# EasyEDA Pro project 立创天空星STM32F407主板.eprj, schematic Schematic1 (continued)
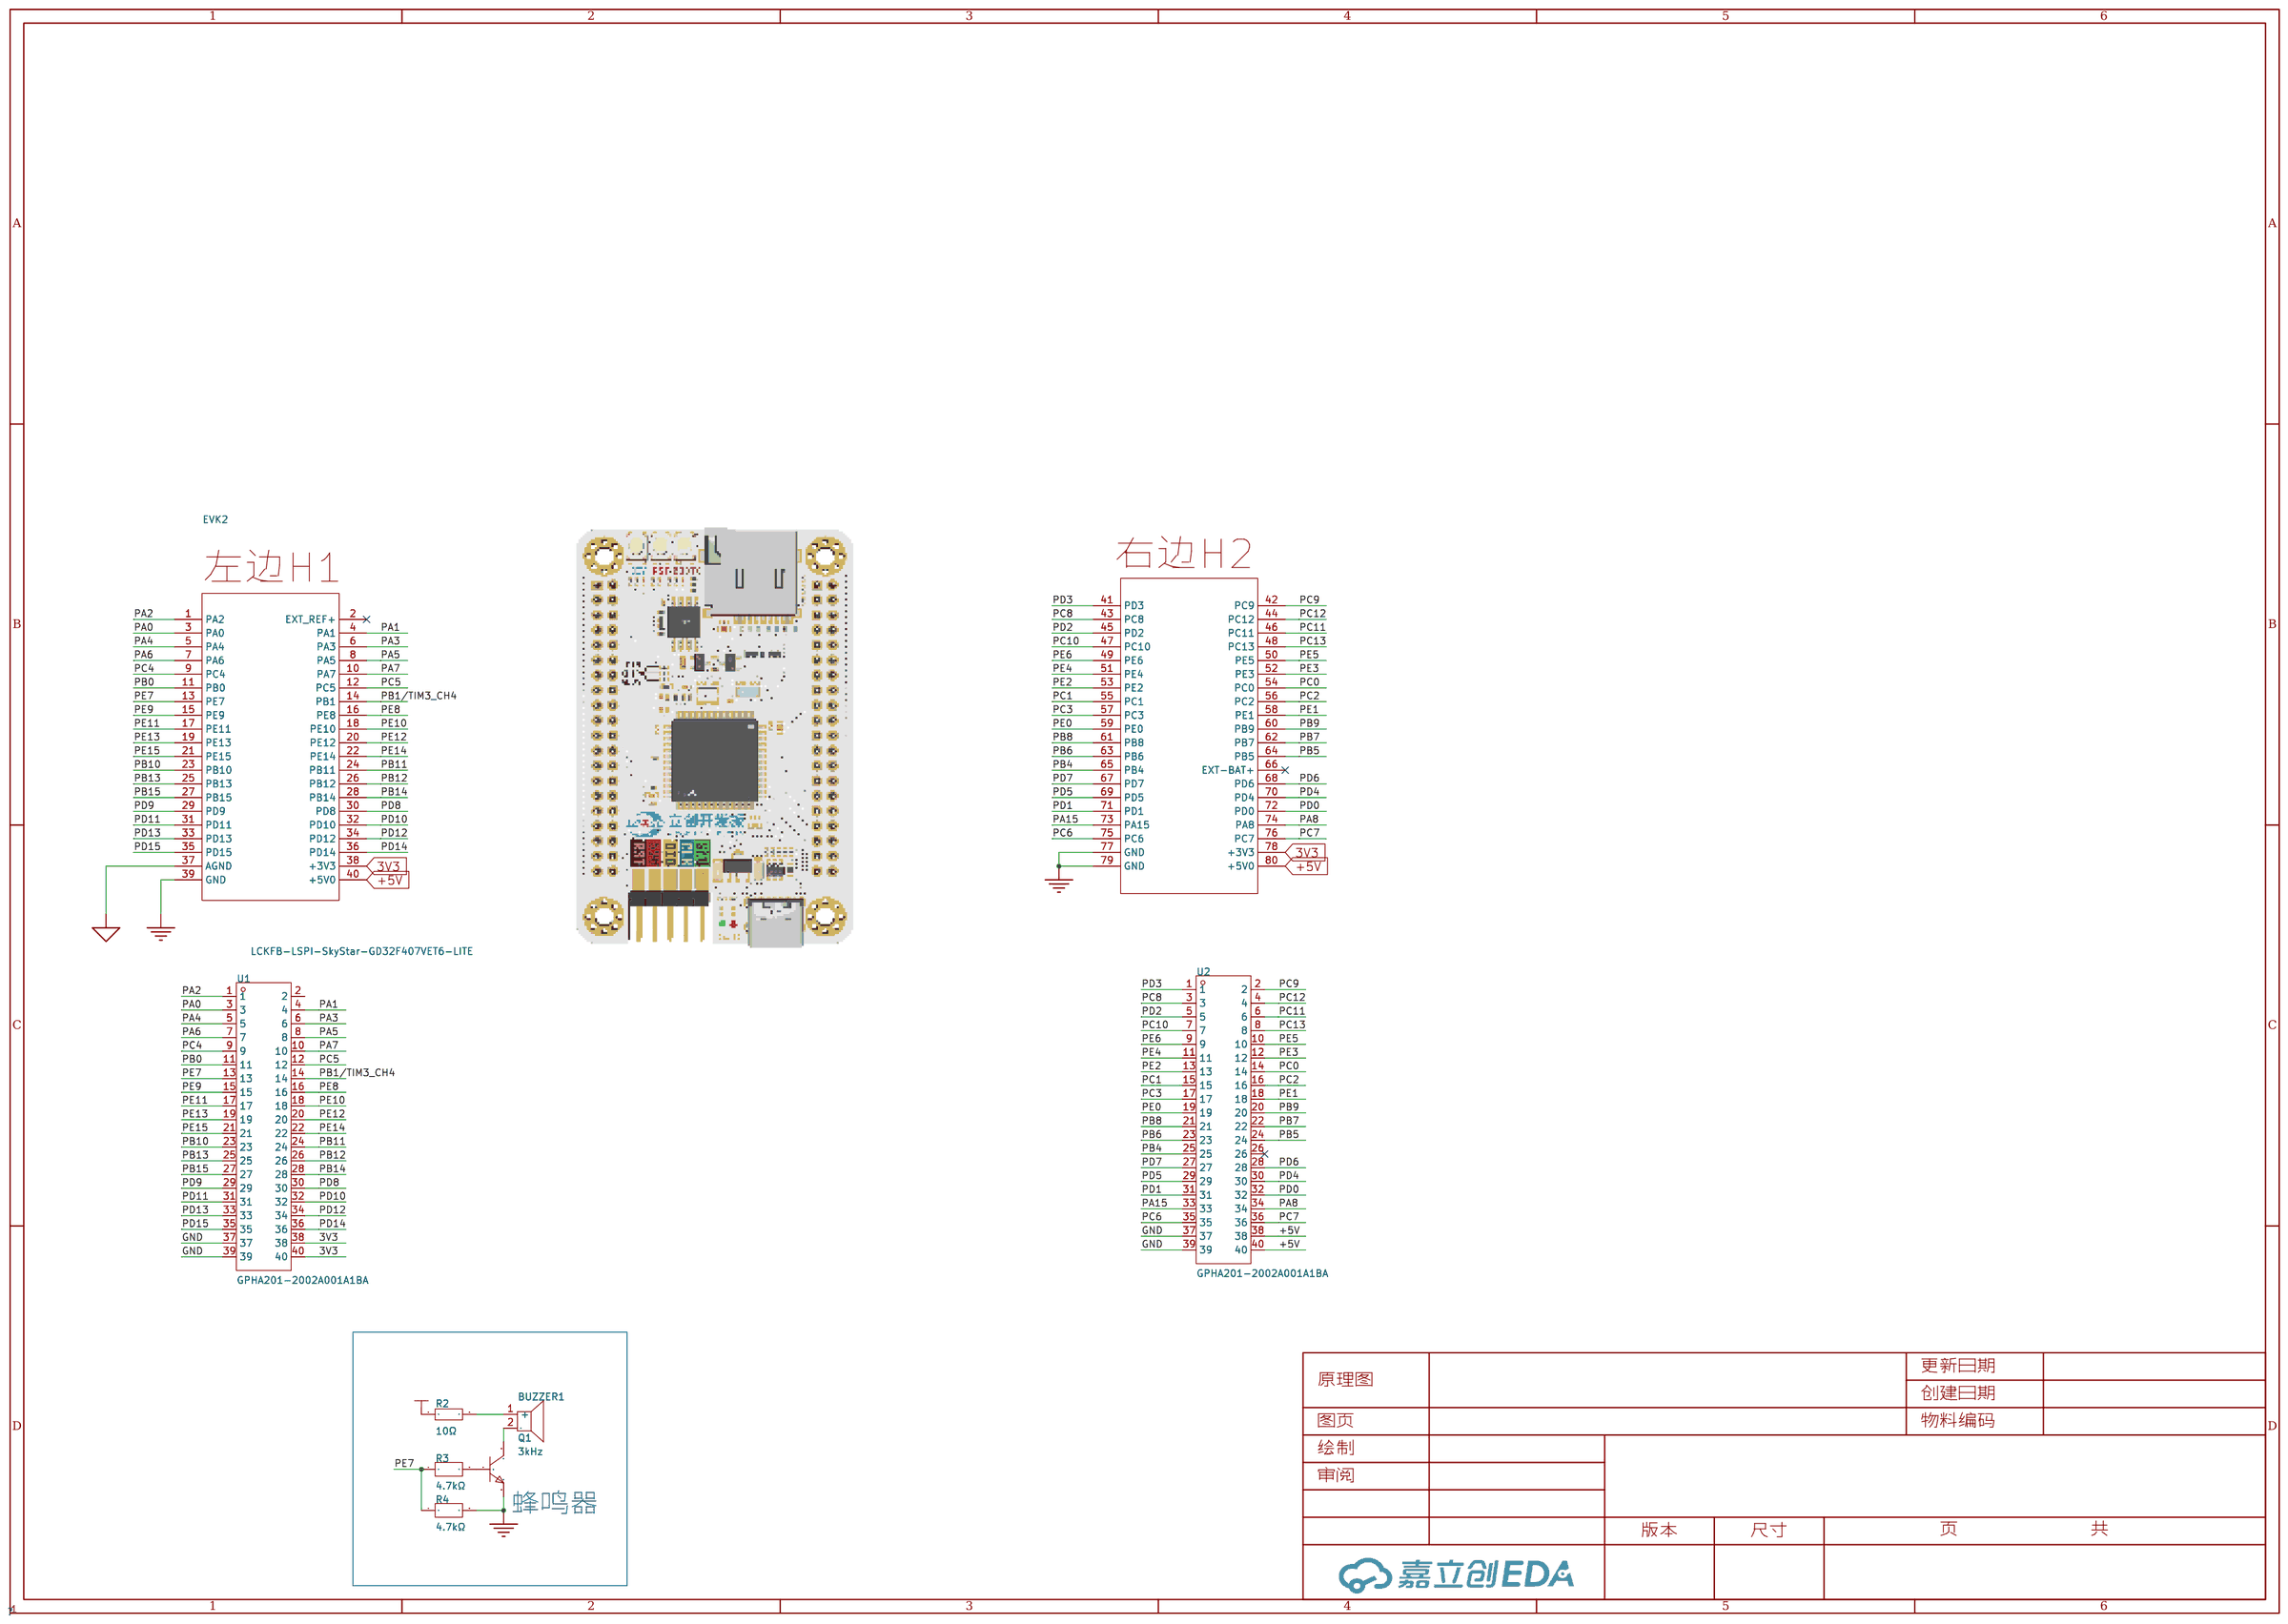
[diagram p0: 核心+音频输出]
## Parts
sheet 扩展模块
C22  100nF  [C0805]
C23  100nF  [C0805]
H14  PZ254V-11-02P  [HDR-TH_2P-P2.54-V-M]
R42  10K  [R0805]
R43  10K  [R0805]
R44  10K  [R0805]
R45  10K  [R0805]
SW6  TS-1101-C-W  [SW-SMD_L6.0-W3.3-LS8.0]
U13  WT8266-S5 ESP-12F  [WIRELM-SMD_WT8266-S5-ESP-12F]
sheet 核心+音频输出
BUZZER1  3kHz  [BUZ-TH_BD9.6-P5.00-D0.7-FD]
EVK2  LCKFB-LSPI-SkyStar-GD32F407VET6-LITE  [DIP-80_L44.97-W69.97-P2.54X2-LS35.9]
Q1  S8050 J3Y(RANGE:200-350)  [SOT-23-3_L3.0-W1.7-P0.95-LS2.9-BR]
R2  10Ω  [R0603]
R3  4.7kΩ  [R0603]
R4  4.7kΩ  [R0603]
U1  GPHA201-2002A001A1BA  [HDR-TH_40P-P2.54-V-M-R2-C20-S2.54]
U2  GPHA201-2002A001A1BA  [HDR-TH_40P-P2.54-V-M-R2-C20-S2.54]
sheet 用户模块
C19  47uF  [CASE-B_3528]
C20  100nF  [C0402]
C21  100nF  [C0402]
H3  -  [HDR-TH_3P-P2.54-V-M]
H4  -  [HDR-TH_3P-P2.54-V-M]
H5  PM254V-12-08-H85  [HDR-TH_8P-P2.54-V-F-R2-C4-S2.54]
H8  2.54-2*3  [HDR-TH_6P-P2.54-V-R2-C3-S2.54_A2541WV-2X3P]
H9  2.54-2*3  [HDR-TH_6P-P2.54-V-R2-C3-S2.54_A2541WV-2X3P]
H10  2.54-2*3  [HDR-TH_6P-P2.54-V-R2-C3-S2.54_A2541WV-2X3P]
H11  HC-PZ254-13.8L-1x9PWA  [HDR-TH_9P-P2.54-H-M-W10.4-N]
H12  -  [HDR-TH_4P-P2.54-V-F]
H13  PZ254V-11-06P  [HDR-TH_6P-P2.54-V-M]
H15  -  [HDR-TH_3P-P2.54-V-M]
H16  KH-2.54PH180-1X4P-L11.5  [HDR-TH_4P-P2.54-V-M]
H17  KH-2.54PH180-1X4P-L11.5  [HDR-TH_4P-P2.54-V-M]
L1  4.7uH  [IND-SMD_L5.4-W5.2_FXL0530]
LED1  NCD0805R1  [LED0805-R-RD]
LED3  NCD0805R1  [LED0805-R-RD]
P1  2.54-1*8P母环保  [HDR-TH_8P-P2.54-V-F-1]
P2  2.54-1*8P母环保  [HDR-TH_8P-P2.54-V-F-1]
Q3  AO3400A  [SOT-23-3_L2.9-W1.3-P1.90-LS2.4-BR]
Q4  AO3400A  [SOT-23-3_L2.9-W1.3-P1.90-LS2.4-BR]
Q5  AO3400A  [SOT-23-3_L2.9-W1.3-P1.90-LS2.4-BR]
R21  100Ω  [R0603]
R22  100Ω  [R0603]
R23  10K  [R0805]
R24  10K  [R0805]
R25  10K  [R0603]
R26  10K  [R0603]
R29  100Ω  [R0603]
R30  100Ω  [R0603]
R31  1KΩ  [R0603]
R34  10K  [R0603]
R46  100Ω  [R0603]
R47  100Ω  [R0603]
R48  10K  [R0603]
R49  10K  [R0402]
R50  4.7K  [R0402]
R51  10K  [R0402]
R52  4.7K  [R0402]
R53  10K  [R0402]
R54  4.7K  [R0402]
R55  10K  [R0603]
SW1  TS-1101-C-W  [SW-SMD_L6.0-W3.3-LS8.0]
SW2  TS-1101-C-W  [SW-SMD_L6.0-W3.3-LS8.0]
SW3  TS-1101-C-W  [SW-SMD_L6.0-W3.3-LS8.0]
SW4  TS-1101-C-W  [SW-SMD_L6.0-W3.3-LS8.0]
U10  SN74LS165ADR  [SOIC-16_L9.9-W3.9-P1.27-LS6.0-BL]
U11  SN74LS165ADR  [SOIC-16_L9.9-W3.9-P1.27-LS6.0-BL]
U12  WAFER-GH1.25-4PWB  [CONN-SMD_4P-P1.25_XUNPU_WAFER-GH1.25-4PWB]
X1  AFC07-S18FCA-00  [FPC-SMD_AFC07-S18FCA-00]
sheet 电源
C2  100nF  [C0603]
C3  100nF  [C0603]
C4  47uF  [C1206]
C5  100uF  [CAP-SMD_BD6.3-L6.6-W6.6-LS7.6-FD-1]
C6  47uF  [C1206]
C7  100uF  [CAP-SMD_BD6.3-L6.6-W6.6-LS7.6-FD-1]
C9  4.7nF  [C0603]
C10  4.7nF  [C0603]
C11  100uF  [CAP-SMD_BD6.3-L6.6-W6.6-LS7.6-FD-1]
C12  4.7uF  [C1206]
C13  100nF  [C0603]
C14  100uF  [CAP-SMD_BD6.3-L6.6-W6.6-LS7.6-FD-1]
C15  4.7uF  [C1206]
C16  100nF  [C0603]
C17  10uF  [C0603]
C18  10uF  [C0603]
CN1  XT30U-M  [CONN-TH_XT30U-M]
CN2  WAFER-GH1.25-2PWB  [CONN-TH_2P-P1.25_XUNPU_WAFER-GH1.25-2PWB]
D1  SS54  [SMA_L4.3-W2.6-LS5.0-FD]
D2  SS54  [SMA_L4.3-W2.6-LS5.0-FD]
D3  SS54  [SMA_L4.3-W2.6-LS5.0-FD]
D4  SS54  [SMA_L4.3-W2.6-LS5.0-FD]
D5  BZT52C16  [SOD-123_L2.7-W1.6-LS3.7-RD]
LED2  19-213/Y2C-CQ2R2L/3T(CY)  [LED0603-RD-YELLOW]
LED6  19-213/Y2C-CQ2R2L/3T(CY)  [LED0603-RD-YELLOW]
LED7  KT-0603R  [LED0603-RD]
Q2  HY19P03D  [TO-252-2_L6.6-W6.1-P4.57-LS9.9-TL-CW]
R5  51kΩ  [R0603]
R6  10k  [R0603]
R7  27k  [R0603]
R8  10k  [R0603]
R9  20kΩ  [R0603]
R10  1.5kΩ  [R0603]
R11  20kΩ  [R0603]
R12  50K  [RES-ADJ-SMD_3P-L3.8-W3.7_VGF39NCHXT]
R15  200kΩ  [R0603]
R16  10kΩ  [R0603]
R17  200kΩ  [R0603]
R18  8.2  [R0603]
R19  10kΩ  [R0603]
R20  4.7kΩ  [R0603]
SW7  SS12D10G6  [SW-TH_SHOU-HAN_SS12D10G4]
U3  4.7uH  [IND-SMD_L5.2-W5.2_MCW-0530]
U4  4.7uH  [IND-SMD_L7.2-W6.6_GPSR07X0]
U5  SCT2450STER  [ESOP-8_L4.9-W3.9-P1.27-LS6.0-BL-EP]
U6  SCT2450STER  [ESOP-8_L4.9-W3.9-P1.27-LS6.0-BL-EP]
U7  -  [WIREPAD-4X6]
U8  -  [WIREPAD-4X6]
U9  RT9013-33GB  [SOT-23-5_L3.0-W1.7-P0.95-LS2.8-BL]

## Library data of the parts
C22 C23 = CAP_0603: Supplier Footprint: 0603
H14 = PZ254V-11-02P: 插针结构:1x2P;间距:2.54mm;行距:-;圆针/方针:方针;安装类型:直插;排数:单排;总PIN位数:2P;额定电流:-;额定电压:-;配合针长度:6mm;塑高:2.5mm;端接针长度:3mm;触头材质:黄铜;触头镀层:-;工作温度范围:-40℃~+105℃;颜色:黑色;; LCSC Part Name: 间距:2.54mm 1x2P 直插 方针; Supplier Part: C492401; Manufacturer: XFCN(兴飞); Supplier Footprint: 插件,P=2.54mm; JLCPCB Part Class: 扩展库; Datasheet: https://atta.szlcsc.com/upload/public/pdf/source/20200309/C492401_A812433581A9B211A7FFA413ADDFF0E5.pdf; Supplier: LCSC; Pin Structure: 1x2P; Pitch: 2.54mm; Circluar Pins/Square Pins: 方针; Mounting Type: 直插; Number of Rows: 单排; Number of Pins: 2P; Length of Mating Pin: 6mm; Insulation Height: 2.5mm; Length of End Connection Pin: 3mm; Contact Material: 黄铜; Operating Temperature Range: -40℃~+105℃; Color: 黑色
R23-R26 R34 R42-R45 R48-R55 = Res_0603: Supplier Footprint: 0603
SW1-SW4 SW6 = TS-1101-C-W: 电路结构:单刀单掷;按钮形状:矩形按钮;作用力:260gf;安装方式:立贴;开关长度:6mm;开关宽度:3.6mm;开关高度:2.5mm;带支架:不带;触点电流:50mA;额定电压(AC):-;额定电压(DC):12V;额定功率:-;绝缘电阻:-;带灯:无;机械寿命:5万次;; LCSC Part Name: 6*3.6*2.5mm 立贴 轻触开关; Supplier Part: C318938; Manufacturer: XKB Connectivity(中国星坤); Supplier Footprint: SMD; JLCPCB Part Class: 扩展库; Datasheet: https://atta.szlcsc.com/upload/public/pdf/source/20200227/C318938_C2E53B1EEDE37D980A33616AC086DE53.pdf; Supplier: LCSC; Circuit: 单刀单掷; Actuator Style: 矩形按钮; Operating Force: 260gf; Mounting Style: 立贴; Switch Length: 6mm; Switch Width: 3.6mm; Switch Height: 2.5mm; Strike Gundam: 不带; Contact Current: 50mA; Voltage Rating (DC): 12V; Actuator/Cap Color: 白色带淡绿; With Lamp: 无; Mechanical Life: 5万次; Operating Temperature: -30℃~+85℃
U13 = WT8266-S5 ESP-12F_C784365: Supplier Part: C784365; Manufacturer: Wireless-tag(启明云端); Supplier Footprint: SMD,16x24mm; JLCPCB Part Class: 扩展库; Supplier: LCSC
BUZZER1 = HNB09A05: 驱动方式:有源(内含驱动线路);构造类型:电磁式;频率:3kHz;声压(SPL):85dB;; Supplier Part: C96493; Manufacturer: 华能; Supplier Footprint: 插件,D=9mm; JLCPCB Part Class: 扩展库; Datasheet: https://atta.szlcsc.com/upload/public/pdf/source/20241128/E20AB0BE5F95571B8A04E10305734657.pdf; Supplier: LCSC; Driver Circuitry: 有源(内含驱动线路); Technology: 电磁式; Voltage - Supply: 4V~8V; Sound Pressure Level(SPL): 85dB; Diameter(φD): 9mm; Height: 5.7mm
EVK2 = LCKFB-LSPI-SkyStar-GD32F407VET6-LITE: 单板,不送排针; LCSC Part Name: 立创·天空星开发板-GD32F407VET6-青春版; Supplier Part: C20607214; Manufacturer: 立创开发板; JLCPCB Part Class: 扩展库; Datasheet: https://atta.szlcsc.com/upload/public/pdf/source/20240117/E5B31CAF57E18ACCA1DCAC6024E258DD.pdf; Supplier: LCSC
Q1 = S8050 J3Y(RANGE:200-350): 晶体管类型:NPN;集电极电流(Ic):500mA;集射极击穿电压(Vceo):25V;耗散功率(Pd):300mW;直流电流增益(hFE):200@500mA,1V;; LCSC Part Name: H档(200-350); Supplier Part: C2146; Manufacturer: CJ(江苏长电/长晶); Supplier Footprint: SOT-23; JLCPCB Part Class: 基础库; Datasheet: https://atta.szlcsc.com/upload/public/pdf/source/20231013/FF37B6A000E6CDA75C9C999D2E78731F.pdf; Supplier: LCSC; type: NPN; Current - Collector(Ic): 500mA; Collector - Emitter Voltage VCEO: 25V; Pd - Power Dissipation: 300mW; DC Current Gain: 200@500mA,1V; Transition frequency(fT): 150MHz; Current - Collector Cutoff: 100nA; Vce Saturation(VCE(sat)): 600mV; Operating Temperature: -55℃~+150℃
R2 = ERJH3EF10R0V: 电阻类型:厚膜电阻;阻值:10Ω;精度:±1%;功率:125mW;温度系数:±100ppm/℃;; LCSC Part Name: 10Ω ±1% 125mW 厚膜电阻; Supplier Part: C2842424; Manufacturer: PANASONIC(松下); Supplier Footprint: 0603; JLCPCB Part Class: 扩展库; Datasheet: https://atta.szlcsc.com/upload/public/pdf/source/20240402/B6F698C601AD4A8FA1CA170A6066345C.pdf; Supplier: LCSC; Type: 厚膜电阻; Tolerance: ±1%; Power(Watts): 125mW; Temperature Coefficient: ±100ppm/℃; Operating Temperature Range: -55℃~+175℃
R3 R4 = SY0603BD4K7P: 电阻类型:厚膜电阻;阻值:4.7kΩ;精度:±0.1%;功率:62.5mW;最大工作电压:-;温度系数:±25ppm/℃;; LCSC Part Name: 厚膜电阻 4.7kΩ ±0.1% 62.5mW; Supplier Part: C2913959; Manufacturer: SANYEAR(叁叶源); Supplier Footprint: 0603; JLCPCB Part Class: 扩展库; Datasheet: https://atta.szlcsc.com/upload/public/pdf/source/20210413/C2763786_98157E1BD2D9D1A8B4147C58C12D38F2.pdf; Supplier: LCSC; Type: 厚膜电阻; Tolerance: ±0.1%; Power(Watts): 62.5mW; Temperature Coefficient: ±25ppm/℃
U1 U2 = GPHA201-2002A001A1BA: 插针结构:2x20P;间距:2.54mm;行距:2.54mm;圆针/方针:方针;安装类型:直插;排数:双排;总PIN位数:40P;额定电流:3A;工作温度范围:-40℃~+105℃;; LCSC Part Name: 2x20P 间距:2.54mm 方针 直插; Supplier Part: C7434486; Manufacturer: GREENCONN(格康); Supplier Footprint: 插件,P=2.54mm; JLCPCB Part Class: 扩展库; Datasheet: https://atta.szlcsc.com/upload/public/pdf/source/20230629/613DF7C618537BFD465DA32CACFAE383.pdf; Supplier: LCSC; Pin Structure: 2x20P; Pitch: 2.54mm; Row Spacing: 2.54mm; Circluar Pins/Square Pins: 方针; Mounting Type: 直插; Number of Rows: 双排; Number of Pins: 40P; Current Rating (Max): 3A; Operating Temperature Range: -40℃~+105℃
C19 = TAJB476K010RNJ: 容值:47uF;精度:±10%;额定电压:10V;等效串联电阻:1Ω@100kHz;; LCSC Part Name: 47uF ±10% 10V; Supplier Part: C22036; Manufacturer: Kyocera AVX; Supplier Footprint: CASE-B-3528; JLCPCB Part Class: 扩展库; Datasheet: https://atta.szlcsc.com/upload/public/pdf/source/20160107/1457707750344.pdf; Supplier: LCSC; Tolerance: ±10%; Rated Voltage: 10V; Equivalent Series Resistance(ESR): 1Ω@100kHz; Operating Temperature: -55℃~+125℃
C20 C21 = CAP_0402: Supplier Footprint: 0402
H3 H4 H15 = HDR-M_2.54_1x3P: Supplier Part: C2937625; Supplier Footprint: 插件
H5 = PM254V-12-08-H85: 插孔结构:2x4P;间距:2.54mm;行距:2.54mm;圆孔/方孔:方孔;安装类型:直插;排数:双排;总孔位数:8P;额定电流:3A;额定电压:250V;插孔方向:顶部;塑高:8.5mm;工作温度范围:-40℃~+105℃;; LCSC Part Name: 间距:2.54mm 2x4P 直插; Supplier Part: C2834799; Manufacturer: XFCN(兴飞); Supplier Footprint: 插件,P=2.54mm; JLCPCB Part Class: 扩展库; Datasheet: https://atta.szlcsc.com/upload/public/pdf/source/20200309/C492399_8C441E2934FBB604A89B37A68AA45ECF.pdf; Supplier: LCSC; Holes Structure: 2x4P; Pitch: 2.54mm; Row Spacing: 2.54mm; Circular Hole / Square Hole: 方孔; Mounting Type: 直插; Number of Rows: 双排; Number of Holes: 8P; Current Rating (Max): 3A; Voltage Rating (Max): 250V; Holes Direction: 顶部; Insulation Height: 8.5mm; Operating Temperature Range: -40℃~+105℃
H8-H10 = 2.54-2*3: 插针结构:2x3P;间距:2.54mm;排数:双排;总PIN位数:6P;; Supplier Part: C5116479; Manufacturer: ZHOURI(洲日); Supplier Footprint: 插件,P=2.54mm; JLCPCB Part Class: 扩展库; Datasheet: https://atta.szlcsc.com/upload/public/pdf/source/20220729/7A96040568D3A9F25ED0F1D4F891C529.pdf; Supplier: LCSC; Pin Structure: 2x3P; Pitch: 2.54mm; Number of Rows: 双排; Number of Pins: 6P
H11 = HC-PZ254-13.8L-1x9PWA: 插针结构:1x9P;间距:2.54mm;行距:-;圆针/方针:方针;安装方式:弯插;排数:单排;总PIN位数:9P;额定电流:3A;额定电压:-;配合针长度:6mm;塑高:2.5mm;端接针长度:3mm;触头材质:黄铜;触头镀层:金;工作温度:-40℃~+105℃;颜色:黑色;; LCSC Part Name: 1x9P 间距:2.54mm 方针 弯插; Supplier Part: C41376115; Manufacturer: HC(虹成电子); Supplier Footprint: 弯插,P=2.54mm; Datasheet: https://atta.szlcsc.com/upload/public/pdf/source/20250106/F2696495C9CEF5469B9CAC16FB04A49E.pdf; Supplier: LCSC; Pin Structure: 1x9P; Pitch: 2.54mm; Circluar Pins/Square Pins: 方针; Mounting Type: 弯插; Number of Rows: 单排; Number of Pins: 9P; Current Rating: 3A; Length of Mating Pin: 6mm; Insulation Height: 2.5mm; Length of End Connection Pin: 3mm; Contact Material: 黄铜; Contact Plating: 金; Operating Temperature: -40℃~+105℃; Color: 黑色
H12 = HDR-F_2.54_1x4P: Supplier Part: C2718488; Supplier Footprint: 插件
H13 = PZ254V-11-06P: 插针结构:1x6P;间距:2.54mm;行距:-;圆针/方针:方针;安装方式:直插;排数:单排;总PIN位数:6P;额定电流:-;额定电压:-;配合针长度:6mm;塑高:2.5mm;端接针长度:3mm;触头材质:黄铜;触头镀层:-;工作温度:-40℃~+105℃;颜色:黑色;; LCSC Part Name: 1x6P 间距:2.54mm 方针 直插; Supplier Part: C492405; Manufacturer: XFCN(兴飞); Supplier Footprint: 插件,P=2.54mm; JLCPCB Part Class: 扩展库; Datasheet: https://atta.szlcsc.com/upload/public/pdf/source/20200309/C492405_597F1930F5B55CC3C7FD95458F1C3977.pdf; Supplier: LCSC; Pin Structure: 1x6P; Pitch: 2.54mm; Circluar Pins/Square Pins: 方针; Mounting Type: 直插; Number of Rows: 单排; Number of Pins: 6P; Length of Mating Pin: 6mm; Insulation Height: 2.5mm; Length of End Connection Pin: 3mm; Contact Material: 黄铜; Operating Temperature: -40℃~+105℃; Color: 黑色
H16 H17 = KH-2.54PH180-1X4P-L11.5: 插针结构:1x4P;间距:2.54mm;行距:-;圆针/方针:方针;安装类型:直插;排数:单排;总PIN位数:4P;额定电流:3A;额定电压:-;配合针长度:6mm;塑高:2.5mm;端接针长度:3mm;触头材质:-;工作温度范围:-40℃~+105℃;颜色:黑色;; LCSC Part Name: 间距:2.54mm 1x4P 直插 方针; Supplier Part: C2905435; Manufacturer: kinghelm(金航标); Supplier Footprint: 插件,P=2.54mm; JLCPCB Part Class: 扩展库; Datasheet: https://atta.szlcsc.com/upload/public/pdf/source/20211019/06FD9EA041E66F176E900F61FE678D35.pdf; Supplier: LCSC; Pin Structure: 1x4P; Pitch: 2.54mm; Circluar Pins/Square Pins: 方针; Mounting Type: 直插; Number of Rows: 单排; Number of Pins: 4P; Current Rating (Max): 3A; Length of Mating Pin: 6mm; Insulation Height: 2.5mm; Length of End Connection Pin: 3mm; Operating Temperature Range: -40℃~+105℃; Color: 黑色; Current Rating: 3A; Operating Temperature: -40℃~+105℃
L1 = FXL0530-4R7-M: 电感值:4.7uH;精度:±20%;额定电流:4.5A;饱和电流(Isat):5A;类型:一体成型电感;; LCSC Part Name: 4.7uH ±20% 5A; Supplier Part: C177246; Manufacturer: cjiang(长江微电); Supplier Footprint: SMD,5.2x5.4mm; JLCPCB Part Class: 扩展库; Datasheet: https://atta.szlcsc.com/upload/public/pdf/source/20240426/3189EA8206330E2108542F9E34E540E7.pdf; Supplier: LCSC; Tolerance: ±20%; Rated Current: 4.5A; Saturation Current (Isat): 5A; DC Resistance (DCR): 60mΩ; Type: 一体成型电感
LED1 LED3 = NCD0805R1: 灯头类型:-;发光颜色:红色;正向电压(VF):1.6V~2.6V;功率:65mW;正向电流:20mA;主波长:615nm~630nm;二极管配置:独立二极管;透镜颜色:无色透明透镜;色温:-;发光强度:67mcd~195mcd;发光角度:130°;载带方式:-;工作温度:-30℃~+85℃;; Supplier Part: C84256; Manufacturer: 国星光电; Supplier Footprint: 0805; JLCPCB Part Class: 基础库; Datasheet: https://atta.szlcsc.com/upload/public/pdf/source/20200820/C84256_F0A75A43B3EAD75808600A0514C76B99.pdf; Supplier: LCSC; Emitted Color: 红色; Forward Voltage (VF): 1.6V~2.6V; Power Dissipation: 65mW; Forward Current: 20mA; Dominant Wavelength: 615nm~630nm; Diode Configuration: 独立二极管; Lens Color: 无色透明透镜; Luminous Intensity: 67mcd~195mcd; Viewing Angle: 130°; Operating Temperature: -30℃~+85℃
P1 P2 = 2.54-1*8P母环保: 插孔结构:1x8P;间距:2.54mm;行距:-;安装类型:直插;排数:单排;总孔位数:8P;塑高:-;触头材质:-;触头镀层:-;; LCSC Part Name: 间距:2.54mm 1x8P 直插; Supplier Part: C27438; Manufacturer: BOOMELE(博穆精密); Supplier Footprint: 插件,P=2.54mm; JLCPCB Part Class: 扩展库; Datasheet: https://atta.szlcsc.com/upload/public/pdf/source/20231221/1CA800C6799ED97958773716FAA1BFFE.pdf; Supplier: LCSC; Holes Structure: 1x8P; Pitch: 2.54mm; Mounting Type: 直插; Number of Rows: 单排; Number of Holes: 8P
Q3-Q5 = AO3400A_C347475: 类型:1个N沟道;漏源电压(Vdss):30V;连续漏极电流(Id):5.8A;导通电阻(RDS(on)@Vgs,Id):28mΩ@10V,5.8A;功率(Pd):1.4W;阈值电压(Vgs(th)@Id):1.4V@250uA;; LCSC Part Name: 1个N沟道 耐压:30V 电流:5.8A; Supplier Part: C347475; Manufacturer: UMW(友台半导体); Supplier Footprint: SOT-23; JLCPCB Part Class: 扩展库; Datasheet: https://atta.szlcsc.com/upload/public/pdf/source/20231109/50AB4FB4D66E55864F9B8D027B723C9A.pdf; Supplier: LCSC; Type: 1个N沟道; Drain Source Voltage (Vdss): 30V; Continuous Drain Current (Id): 5.8A; Drain Source On Resistance (RDS(on)@Vgs,Id): 28mΩ@10V,5.8A; Power Dissipation (Pd): 1.4W; Gate Threshold Voltage (Vgs(th)@Id): 1.4V@250uA; Total Gate Charge (Qg@Vgs): 12nC@10V; Input Capacitance (Ciss@Vds): 1.05nF@24V; Reverse Transfer Capacitance (Crss@Vds): 77pF@15V; Operating Temperature: -55℃~+150℃
R21 R22 R29 R30 = RNCP0603FTD100R: 电阻类型:薄膜电阻;阻值:100Ω;精度:±1%;功率:125mW;最大工作电压:150V;温度系数:±100ppm/℃;; LCSC Part Name: 薄膜电阻 100Ω ±1% 125mW; Supplier Part: C2479153; Manufacturer: SEI(Stackpole Electronics Inc.); Supplier Footprint: 0603; JLCPCB Part Class: 扩展库; Datasheet: https://atta.szlcsc.com/upload/public/pdf/source/20210703/569BB8B726E815480678B80ABD78296B.pdf; Supplier: LCSC; Type: 薄膜电阻; Tolerance: ±1%; Power(Watts): 125mW; Overload Voltage (Max): 150V; Temperature Coefficient: ±100ppm/℃; Operating Temperature Range: -55℃~+155℃
R5-R8 R10 R16 R18 R20 R31 R46 R47 = RMC060351K1%N: 阻值:51kΩ;精度:±1%;功率:100mW;; LCSC Part Name: 51kΩ ±1% 100mW; Supplier Part: C325623; Manufacturer: Tyohm(幸亚电阻); Supplier Footprint: 0603; JLCPCB Part Class: 扩展库; Datasheet: https://atta.szlcsc.com/upload/public/pdf/source/20190115/C325956_D27151D492FFB3C9AB4A6F14FE01F30A.pdf; Supplier: LCSC; Tolerance: ±1%; Power(Watts): 100mW
U10 U11 = SN74LS165ADR: 功能:并行或串行至串行;电源电压:4.75V~5.25V;; Supplier Part: C7742; Manufacturer: TI(德州仪器); Supplier Footprint: SOIC-16; JLCPCB Part Class: Extended Part; Datasheet: https://atta.szlcsc.com/upload/public/pdf/source/20140707/1457707138703.pdf; Supplier: LCSC; Series: 74LS; Output Type: 补充型; Function: 并行或串行至串行; Supply Voltage: 4.75V~5.25V; Operating Temperature: 0~+70
U12 = WAFER-GH1.25-4PWB: 插针结构:1x4P;间距:1.25mm;安装方式:卧贴;参考系列:GH;总PIN数:4P;排数:1;每排PIN数:4;行距:-;额定电流:1A;触头材质:黄铜;触头镀层:-;工作温度范围:-25℃~+85℃;; LCSC Part Name: 1x4P 间距:1.25mm 卧贴 系列:GH; Supplier Part: C3029379; Manufacturer: XUNPU(讯普); Supplier Footprint: SMD,P=1.25mm,卧贴; JLCPCB Part Class: 扩展库; Datasheet: https://atta.szlcsc.com/upload/public/pdf/source/20220527/CB8773BFB0913C3B8ABD62CB38BA101A.pdf; Supplier: LCSC; Pins Structure: 1x4P; Pitch: 1.25mm; Mounting Type: 卧贴; Reference Series: GH; Number of Pins: 4P; Number of Rows: 1; Number of PINs Per Row: 4; Current Rating: 1A; Contact Material: 黄铜; Operating Temperature: -25℃~+85℃; Voltage Rating: 125V; Plastic Material: LCP; Supplementary Features: 辅助焊脚; Color: 米色; Z-Height of the Board: 4.35mm; X-Length of Bottom Edge on Board (Spacing Line): 8.25mm; Y-Width of Bottom Edge on Board: 5mm
X1 = AFC07-S18FCA-00: 锁定特性:抽屉式;触点类型:下接;触点数量:18P;间距:0.5mm;安装类型:卧贴;工作温度范围:-;; LCSC Part Name: 间距:0.5mm P数:18P 抽屉式 下接; Supplier Part: C262564; Manufacturer: JS(钜硕电子); Supplier Footprint: SMD,P=0.5mm,卧贴; JLCPCB Part Class: 扩展库; Datasheet: https://atta.szlcsc.com/upload/public/pdf/source/20190726/C11047_78689421E6D6672DE8D11ECCF89B3729.pdf; Supplier: LCSC; Locking Feature: 抽屉式; Contact Type: 下接; Number of Contacts: 18P; Pitch: 0.5mm; Mounting Type: 卧贴; FFC, FCB Thickness: 0.3mm; Height Above Board: 2mm
C2 C3 C9 C10 C13 C16 = CC0603KRX7R6BB104: 容值:100nF;精度:±10%;额定电压:10V;材质(温度系数):X7R;; LCSC Part Name: 100nF ±10% 10V; Supplier Part: C519438; Manufacturer: YAGEO(国巨); Supplier Footprint: 0603; JLCPCB Part Class: 扩展库; Datasheet: https://atta.szlcsc.com/upload/public/pdf/source/20200423/C519438_5D8E3909BA347820A92655F61B0D4FC7.pdf; Supplier: LCSC; Tolerance: ±10%; Voltage Rated: 10V; Temperature Coefficient: X7R
C4 C6 C12 C15 = EMK316BJ475KL-T: 容值:4.7uF;精度:±10%;额定电压:16V;材质(温度系数):X5R;; LCSC Part Name: 4.7uF ±10% 16V; Supplier Part: C92766; Manufacturer: TAIYO YUDEN(太诱); Supplier Footprint: 1206; JLCPCB Part Class: 扩展库; Datasheet: https://atta.szlcsc.com/upload/public/pdf/source/20210525/C2802164_C0429B055888A674C3F00BA74B841C5B.pdf; Supplier: LCSC; Tolerance: ±10%; Voltage Rated: 16V; Temperature Coefficient: X5R
C5 C7 C11 C14 = RVE100UF35V67RV0072: 容值:100uF;精度:±20%;额定电压:35V;纹波电流:230mA@120Hz;等效串联电阻:600mΩ@100kHz;; LCSC Part Name: 100uF ±20% 35V; Supplier Part: C2836437; Manufacturer: KNSCHA(科尼盛); Supplier Footprint: SMD,D6.3xL7.7mm; JLCPCB Part Class: 扩展库; Datasheet: https://atta.szlcsc.com/upload/public/pdf/source/20220719/B52EB46F8A1558448ED03D8B4CB3C24F.pdf; Supplier: LCSC; Tolerance: ±20%; Rated Voltage: 35V; Ripple Current: 230mA@120Hz; Equivalent Series Resistance(ESR): 600mΩ@100kHz; φD: 6.3mm; L: 7.7mm; Lifetime @ Temp: 2000hrs@105℃; Operating Temperature: -55℃~+105℃
C17 C18 = CGA0603X5R106K100JT: 容值:10uF;精度:±10%;额定电压:10V;材质(温度系数):X5R;; LCSC Part Name: 10uF ±10% 10V; Supplier Part: C6119842; Manufacturer: HRE(芯声); Supplier Footprint: 0603; JLCPCB Part Class: 扩展库; Supplier: LCSC; Tolerance: ±10%; Voltage Rated: 10V; Temperature Coefficient: X5R
CN1 = XT30U-M: 类别:-;类型1:-;; LCSC Part Name: AMASS(艾迈斯)轻量版锂电池插头公头 XT30U-M; Supplier Part: C99101; Manufacturer: AMASS(艾迈斯); JLCPCB Part Class: 扩展库; Datasheet: https://atta.szlcsc.com/upload/public/pdf/source/20170606/1496716542582.pdf; Supplier: LCSC; Brand: 艾迈斯; Type: 插头; Colour: 黄色; InterfaceType: 公头
CN2 = WAFER-GH1.25-2PWB: 插针结构:1x2P;间距:1.25mm;安装方式:卧贴;参考系列:GH;总PIN数:2P;排数:1;每排PIN数:2;行距:-;额定电流:1A;触头材质:黄铜;触头镀层:-;工作温度范围:-25℃~+85℃;; LCSC Part Name: 1x2P 间距:1.25mm 卧贴 系列:GH; Supplier Part: C3029377; Manufacturer: XUNPU(讯普); Supplier Footprint: SMD,P=1.25mm,卧贴; JLCPCB Part Class: 扩展库; Datasheet: https://atta.szlcsc.com/upload/public/pdf/source/20220527/CB8773BFB0913C3B8ABD62CB38BA101A.pdf; Supplier: LCSC; Pins Structure: 1x2P; Pitch: 1.25mm; Mounting Type: 卧贴; Reference Series: GH; Number of Pins: 2P; Number of Rows: 1; Number of PINs Per Row: 2; Current Rating: 1A; Contact Material: 黄铜; Operating Temperature: -25℃~+85℃; Voltage Rating: 125V; Plastic Material: LCP; Supplementary Features: 辅助焊脚; Color: 米色; Z-Height of the Board: 4.35mm; X-Length of Bottom Edge on Board (Spacing Line): 5.75mm; Y-Width of Bottom Edge on Board: 5mm
D1-D4 = SS54_C7420369: 二极管配置:独立式;正向压降(Vf):550mV@5.0A;直流反向耐压(Vr):40V;整流电流:5A;; LCSC Part Name: 电压:40V 电流:5A; Supplier Part: C7420369; Manufacturer: 宏迦橙; Supplier Footprint: SMA(DO-214AC); JLCPCB Part Class: 扩展库; Datasheet: https://atta.szlcsc.com/upload/public/pdf/source/20230828/254C3882F8647358AD9F60DD73611B5E.pdf; Supplier: LCSC; Diode Configuration: 独立式; Forward Voltage (Vf@If): 550mV@5.0A; Reverse Voltage (Vr): 40V; Rectified Current: 5A; Reverse Leakage Current (Ir): 50uA@40V
D5 = BZT52C16_C19077413: 二极管配置:独立式;稳压值(标称值):16V;稳压值(范围):15.2V~16.8V;耗散功率(Pd):500mW;; Supplier Part: C19077413; Manufacturer: 宏嘉诚; Supplier Footprint: SOD-123; JLCPCB Part Class: 扩展库; Datasheet: https://atta.szlcsc.com/upload/public/pdf/source/20250106/E12AA82D484C9C66E469D005F460C1F7.pdf; Supplier: LCSC; Diode Configuration: 独立式; Zener Voltage(Nom): 16V; Reverse Leakage Current (Ir): 100nA@11.2V; Zener Voltage(Range): 15.2V~16.8V; Pd - Power Dissipation(Pd): 500mW; Impedance(Zzt): 45Ω
LED2 LED6 = 19-213/Y2C-CQ2R2L/3T(CY): 发光颜色:黄色;功率:60mW;正向电流:20mA;主波长:585.5nm~591.5nm;二极管配置:-;透镜颜色:无色透明透镜;色温:-;发光角度:120°;载带方式:-;工作温度:-40℃~+85℃;; LCSC Part Name: 黄灯; Supplier Part: C72038; Manufacturer: EVERLIGHT(亿光); Supplier Footprint: 0603; JLCPCB Part Class: 基础库; Datasheet: https://atta.szlcsc.com/upload/public/pdf/source/20160507/1462613613586.pdf; Supplier: LCSC; Emitted Color: 黄色; Power Dissipation: 60mW; Forward Current: 20mA; Dominant Wavelength: 585.5nm~591.5nm; Peak Wavelength: 591nm; Lens Color: 无色透明透镜; Viewing Angle: 120°; Operating Temperature: -40℃~+85℃
LED7 = KT-0603R: 发光颜色:红色;功率:-;正向电流:-;主波长:-;二极管配置:-;透镜颜色:-;色温:-;发光角度:-;载带方式:-;工作温度:-40℃~+85℃;; LCSC Part Name: 0603 红灯 高亮; Supplier Part: C2286; Manufacturer: KENTO; Supplier Footprint: 0603; JLCPCB Part Class: 基础库; Datasheet: https://atta.szlcsc.com/upload/public/pdf/source/20160616/1466072038404.pdf; Supplier: LCSC; Emitted Color: 红色; Operating Temperature: -40℃~+85℃
Q2 = HY19P03D: 类型:P沟道;漏源电压(Vdss):30V;连续漏极电流(Id):90A;功率(Pd):50W;导通电阻(RDS(on)@Vgs,Id):6mΩ@10V,45A;阈值电压(Vgs(th)@Id):3V@250uA;; LCSC Part Name: P沟道 耐压:30V 电流:90A; Supplier Part: C122492; Manufacturer: HUAYI(华羿微); Supplier Footprint: TO-252-2; JLCPCB Part Class: 扩展库; Datasheet: https://atta.szlcsc.com/upload/public/pdf/source/20170728/C122492_1501225751911848809.pdf; Supplier: LCSC; Type: P沟道; Drain Source Voltage (Vdss): 30V; Continuous Drain Current (Id): 90A; Power Dissipation (Pd): 50W; Drain Source On Resistance (RDS(on)@Vgs,Id): 6mΩ@10V,45A; Gate Threshold Voltage (Vgs(th)@Id): 3V@250uA
R9 R11 R15 R17 = AR03BTCX2003: 阻值:200kΩ;精度:±0.1%;功率:100mW;温度系数:±25ppm/℃;; LCSC Part Name: 200kΩ ±0.1% 100mW; Supplier Part: C319781; Manufacturer: Viking(光颉); Supplier Footprint: 0603; JLCPCB Part Class: 扩展库; Datasheet: https://atta.szlcsc.com/upload/public/pdf/source/20191129/C465721_10D49275DB41E427863CE9C8D788770A.pdf; Supplier: LCSC; Tolerance: ±0.1%; Power(Watts): 100mW; Temperature Coefficient: ±25ppm/℃
R12 = VGF39NCHXT-B103: 阻值:10kΩ;精度:±25%;功率:150mW;; LCSC Part Name: 可调电阻; Supplier Part: C22461454; Manufacturer: HDK(北陆电气); Supplier Footprint: SMD; Datasheet: https://atta.szlcsc.com/upload/public/pdf/source/20240611/DF6B3C034EBEB567190CC0E572E80C48.pdf; Supplier: LCSC; Tolerance: ±25%; Power(Watts): 150mW
R19 = TR0603B10K0P0525Z: 电阻类型:薄膜电阻;阻值:10kΩ;精度:±0.1%;功率:100mW;最大工作电压:75V;温度系数:±25ppm/℃;; LCSC Part Name: 薄膜电阻 10kΩ ±0.1% 100mW; Supplier Part: C188363; Manufacturer: EVER OHMS(天二科技); Supplier Footprint: 0603; JLCPCB Part Class: 扩展库; Datasheet: https://atta.szlcsc.com/upload/public/pdf/source/20190527/C149900_32B1354086E9F6A772108AB7B2B7A514.pdf; Supplier: LCSC; Type: 薄膜电阻; Tolerance: ±0.1%; Power(Watts): 100mW; Overload Voltage (Max): 75V; Temperature Coefficient: ±25ppm/℃; Operating Temperature Range: -55℃~+155℃
SW7 = SS12D10G6: 电路结构:单刀双掷;安装方式:直插;额定电流:2A;额定电压:125V;工作寿命:3千次;; LCSC Part Name: 两档立式插件 3脚拨动开关 柄长6.0mm; Supplier Part: C7431055; Manufacturer: SHOU HAN(首韩); Supplier Footprint: 插件; Datasheet: https://atta.szlcsc.com/upload/public/pdf/source/20231130/59B46964A334F2EAD7849AEEA09A75AE.pdf; Supplier: LCSC; Circuit: 单刀双掷; Length: 12.7mm; Width: 6.7mm; Mounting Type: 直插; Current Rating: 2A; Voltage Rating: 125V; Life: 3千次; Operating Temperature: -25℃~+70℃
U3 U4 = CYA0630-4.7UH: 电感值:4.7uH;精度:±20%;额定电流:5A;直流电阻(DCR):34.5mΩ;; LCSC Part Name: 4.7uH ±20%; Supplier Part: C5189748; Manufacturer: SHOU HAN(首韩); Supplier Footprint: SMD,7.2x6.6mm; JLCPCB Part Class: 扩展库; Datasheet: https://atta.szlcsc.com/upload/public/pdf/source/20221010/79ACBE86DD414F23A670753564343C1B.pdf; Supplier: LCSC; Tolerance: ±20%; Rated Current: 5A; DC Resistance (DCR): 34.5mΩ
U5 U6 = SCT2450STER: 功能类型:降压型;工作电压:3.8V~36V;输出电流:5A;; LCSC Part Name: 3.8V-36V输入，5A输出，高效率同步降压DC-DC转换器; Supplier Part: C509400; Manufacturer: SCT(芯洲科技); Supplier Footprint: ESOP-8; JLCPCB Part Class: 扩展库; Datasheet: https://atta.szlcsc.com/upload/public/pdf/source/20200407/C509400_EDF779A672A59398CFBA9E95FA584FEC.pdf; Supplier: LCSC; Function: 降压型; Input Voltage: 3.8V~36V; Output Current: 5A; Switching Frequency: 100kHz~1.1MHz; Operating Temperature: -40℃~+125℃@(TJ); Synchronous Rectification: 是; Number of Outputs: 1; Switch tube (built-in/external): 内置
U7 U8 = 焊盘
U9 = RT9013-33GB: 输出类型:固定;最大输入电压:5.5V;输出电压:3.3V;输出电流:500mA;电源纹波抑制比(PSRR):50dB@(10kHz);输出极性:正极;; LCSC Part Name: 输入5.5V 输出3.3V 500mA; Supplier Part: C47773; Manufacturer: RICHTEK(立锜); Supplier Footprint: SOT-23-5; JLCPCB Part Class: 扩展库; Datasheet: https://atta.szlcsc.com/upload/public/pdf/source/20150504/1457707282459.pdf; Supplier: LCSC; Output Type: 固定; Maximum Input Voltage: 5.5V; Output Voltage: 3.3V; Output Current: 500mA; Power Supply Rejection Ratio (PSRR): 50dB@(10kHz); Dropout Voltage: 400mV@(500mA); standby current: 50uA; Feature: 低ESR；防静电保护；热保护(TSD)；过流保护(OCP)；带使能; Operating Temperature: -40℃~+85℃; Output Polarity: 正极; Number of Outputs: 1

## Nets
3V3: C18.2 C22.2 C23.2 EVK2.38(+3V3) EVK2.78(+3V3) H9.2 H10.2 H11.9 H12.1 P1.2 P2.1 Q3.1(G) Q4.1(G) Q5.1(G) R2.1 R20.2 R31.2 R34.2 R42.1 R43.1 R44.1 R50.2 R52.2 R54.2 U1.38 U1.40 U9.5(VOUT) U12.4 U13.8(VCC) X1.18
+5V: C17.2 D1.2(K) EVK2.40(+5V0) EVK2.80(+5V0) H13.1 H16.1 H17.1 L1.1 R5.2 R6.2 R55.2 U2.38 U2.40 U9.1(VIN) U9.3(EN)
AGND: EVK2.37(AGND)
GND: C4.1 C5.2 C6.1 C7.2 C9.2 C10.2 C11.2 C12.1 C13.1 C14.2 C15.1 C16.1 C17.1 C18.1 C19.2 C20.2 C21.2 C22.1 C23.1 CN1.2 CN2.1 EVK2.39(GND) EVK2.77(GND) EVK2.79(GND) H3.1 H4.1 H5.5 H5.6 H8.3 H8.4 H9.1 H10.1 H11.8 H12.4 H13.2 H15.1 H16.2 H17.2 LED1.1(+) LED2.1(C) LED3.1(+) LED6.1(C) LED7.1(K) P1.1 P2.2 Q1.2(E) R4.2 R15.2 R16.1 R17.2 R18.1 R19.1 R45.1 SW1.2 SW2.2 SW3.2 SW4.2 SW6.2 U1.37 U1.39 U2.37 U2.39 U5.7(GND) U5.9(EP) U6.7(GND) U6.9(EP) U8.1 U9.2(GND) U10.8(GND) U10.15(CLKINH) U11.8(GND) U11.15(CLKINH) U12.1 U13.9(GND) X1.17
VCC: D5.1(K) Q2.3(S) SW7.1 U7.1
VCCBAT: CN1.1 CN2.2 D3.1(A) D4.1(A) Q2.2(D)
VCCSERVO: D2.2(K) H3.2 H4.2 H15.2 R7.2 R8.2
AD1: EVK2.57(PC3) H11.7 U2.17
AD2: EVK2.56(PC2) H11.6 U2.16
AD3: EVK2.55(PC1) H11.5 U2.15
AD4: EVK2.54(PC0) H11.4 U2.14
AD5: EVK2.9(PC4) H11.3 U1.9
AD6: EVK2.12(PC5) H11.2 U1.12
AD7: EVK2.11(PB0) H11.1 U1.11
CLK: Q4.3(D) R51.1 U10.2(CLK) U11.2(CLK)
CLK_IN: EVK2.63(PB6) Q4.2(S) R52.1 U2.23
DATA: Q5.3(D) R53.1 U10.9(QH)
DATA_IN: EVK2.64(PB5) Q5.2(S) R54.1 U2.24
ECD1_DIR: EVK2.51(PE4) H9.4 U2.11
ECD1_PULSE: EVK2.49(PE6) H9.3 U2.9
ECD2_DIR: EVK2.4(PA1) H10.4 U1.4
ECD2_PULSE: EVK2.3(PA0) H10.3 U1.3
ECHO: EVK2.23(PB10) H12.3 H13.3 U1.23
ESP/RX: EVK2.1(PA2) H14.2 U1.1 U13.15(RXD0)
ESP/TX: EVK2.6(PA3) H14.1 U1.6 U13.16(TXD0)
ICM_CS: EVK2.5(PA4) P2.6 U1.5
ICM_MISO: EVK2.7(PA6) P2.5 U1.7
ICM_MOSI: EVK2.10(PA7) P2.4 U1.10
ICM_SCK: EVK2.8(PA5) H5.8 P2.3 U1.8
IIC_SCK: EVK2.61(PB8) U2.21 U12.2
IIC_SDA: EVK2.60(PB9) U2.20 U12.3
IN1: U10.6(H) X1.1
IN2: U10.5(G) X1.2
IN3: U10.4(F) X1.3
IN4: U10.3(E) X1.4
IN5: U10.14(D) X1.5
IN6: U10.13(C) X1.6
IN7: U10.12(B) X1.7
IN8: U10.11(A) X1.8
IN9: U11.6(H) X1.9
IN10: U11.5(G) X1.10
IN11: U11.4(F) X1.11
IN12: U11.3(E) X1.12
IN13: U11.14(D) X1.13
IN14: U11.13(C) X1.14
IN15: U11.12(B) X1.15
IN16: U11.11(A) X1.16
IPS_BL: P1.8 R31.1
IPS_CS: EVK2.26(PB12) P1.7 U1.26
IPS_DC: EVK2.34(PD12) P1.6 U1.34
IPS_MOSI: EVK2.27(PB15) R47.1 U1.27
IPS_RST: EVK2.28(PB14) P1.5 U1.28
IPS_SCK: EVK2.25(PB13) R46.1 U1.25
PA8: EVK2.74(PA8) R26.2 U2.34
PA15: EVK2.73(PA15) U2.33
PB1/TIM3_CH4: EVK2.14(PB1) U1.14
PB4: EVK2.65(PB4) Q3.2(S) R50.1 U2.25
PB7: EVK2.62(PB7) U2.22
PB11: EVK2.24(PB11) H12.2 H13.4 U1.24
PC6: EVK2.75(PC6) R48.2 U2.35
PC7: EVK2.76(PC7) R25.2 U2.36
PC8: EVK2.43(PC8) R29.1 U2.3
PC9: EVK2.42(PC9) R21.1 U2.2
PC10: EVK2.47(PC10) H16.4 U2.7
PC11: EVK2.46(PC11) H16.3 R30.2 U2.6
PC12: EVK2.44(PC12) H17.4 U2.4
PC13: EVK2.48(PC13) U2.8
PD0: EVK2.72(PD0) U2.32
PD1: EVK2.71(PD1) U2.31
PD2: EVK2.45(PD2) H17.3 U2.5
PD3: EVK2.41(PD3) R22.2 U2.1
PD4: EVK2.70(PD4) U2.30
PD5: EVK2.69(PD5) U2.29
PD6: EVK2.68(PD6) U2.28
PD7: EVK2.67(PD7) U2.27
PD8: EVK2.30(PD8) H5.1 U1.30
PD9: EVK2.29(PD9) H5.3 U1.29
PD10: EVK2.32(PD10) SW3.1 U1.32
PD11: EVK2.31(PD11) SW4.1 U1.31
PD13: EVK2.33(PD13) U1.33
PD14: EVK2.36(PD14) U1.36
PD15: EVK2.35(PD15) U1.35
PE0: EVK2.59(PE0) U2.19
PE1: EVK2.58(PE1) U2.18
PE2: EVK2.53(PE2) U2.13
PE3: EVK2.52(PE3) U2.12
PE5: EVK2.50(PE5) U2.10
PE7: EVK2.13(PE7) R3.1 R4.1 U1.13
PE8: EVK2.16(PE8) U1.16
PE9: EVK2.15(PE9) H5.4 U1.15
PE10: EVK2.18(PE10) R23.2 U1.18
PE11: EVK2.17(PE11) R24.2 U1.17
PE12: EVK2.20(PE12) SW1.1 U1.20
PE13: EVK2.19(PE13) U1.19
PE14: EVK2.22(PE14) U1.22
PE15: EVK2.21(PE15) SW2.1 U1.21
SH: Q3.3(D) R49.1 U10.1(SH/LD#) U11.1(SH/LD#)
VD: C20.1 C21.1 R49.2 R51.2 R53.2 R55.1 U10.16(VCC) U11.16(VCC)
$1N8508: Q1.1(B) R3.2
$1N8510: BUZZER1.2 Q1.3(C)
$1N8512: BUZZER1.1(+) R2.2
$2N1085: LED1.2(-) R23.1
$2N1087: LED3.2(-) R24.1
$2N16423: H8.2 R22.1
$2N16424: H8.6 R21.2
$2N16425: H8.5 R29.2
$2N16426: H8.1 R30.1
$2N16659: H13.5 R34.1
$2N17066: H3.3 R25.1
$2N17071: H4.3 R26.1
$2N17434: C19.1 H5.7 L1.2
$2N17714: P1.3 R46.2
$2N17715: P1.4 R47.2
$2N18202: H15.3 R48.1
$2N22566: U10.10(SER) U11.9(QH)
$3N925: R42.2 U13.1(RST)
$3N927: R43.2 U13.3(EN)
$3N1259: R45.2 U13.10(IO15)
$3N2980: R44.2 SW6.1 U13.12(IO0)
$4N307: Q2.1(G) SW7.2
$4N309: D5.2(A) R19.2 SW7.3
$4N1990: C2.1 U5.1(BOOT)
$4N1991: C2.2 U3.1 U5.8(SW)
$4N1992: C11.1 C12.2 C13.2 D3.2(K) U5.2(VIN) U5.3(EN)
$4N1993: R15.1 U5.4(RT/CLK)
$4N1994: R9.2 U5.6(COMP)
$4N1996: C4.2 C5.1 D1.1(A) U3.2
$4N1999: R5.1 R10.2
$4N2000: R10.1 R16.2 U5.5(FB)
$4N2002: LED6.2(A) R6.1
$4N2003: C9.1 R9.1
$4N2008: LED7.2(A) R20.1
$4N2009: C3.1 U6.1(BOOT)
$4N2010: C3.2 U4.1 U6.8(SW)
$4N2011: C14.1 C15.2 C16.2 D4.2(K) U6.2(VIN) U6.3(EN)
$4N2012: R17.1 U6.4(RT/CLK)
$4N2013: R11.2 U6.6(COMP)
$4N2015: C6.2 C7.1 D2.1(A) U4.2
$4N2018: LED2.2(A) R8.1
$4N2019: C10.1 R11.1
$4N2021: R7.1 R12.1
$4N2022: R12.3 R18.2
$4N2023: R12.2 U6.5(FB)

Not connected (* = marked no-connect by the designer): CN2 3* 4*; EVK2 2(EXT REF+)* 66(EXT-BAT+)*; H5 2*; H9 5* 6*; H10 5* 6*; H13 6*; P2 7* 8*; U1 2; U2 26*; U9 4(NC)*; U10 7(QH#)*; U11 7(QH#)* 10(SER)*; U12 5* 6*; U13 2(ADC) 4(IO16) 5(IO14) 6(IO12) 7(IO13) 11(IO2) 13(IO4) 14(IO5) 17(CS0) 18(MISO) 19(GPIO9) 20(GPIO0) 21(MOSI) 22(SCLK); X1 19* 20*

## Notes on the sheets
sheet 1
- 蜂鸣器
sheet 2
- LED
- 串口2
- 编码器
- 按键电路
- 串口1
- 有刷
- 舵机
- 无线串口
- 屏幕接口
- 七路灰度循迹
- 姿态传感器
- 超声波
- TOF
sheet 3
- ESP8266/WIFI模块
sheet 4
- 5v
- 开关
- 5V电源
- 舵机电源
- 3v3
- 电机供电
